# Altium schematic sheet ProbadorDeCables_Accesorios_B_CPC14.SchDoc
size A4
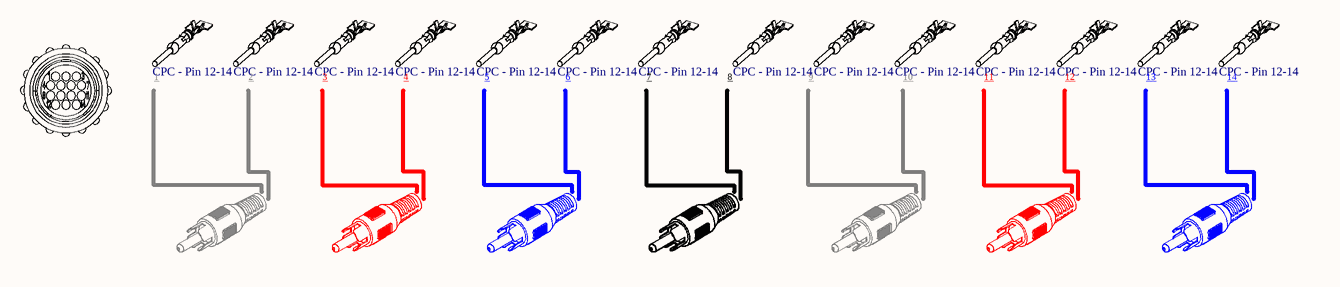
[diagram p0: ProbadorDeCables_Accesorios_B_CPC14.SchDoc]

## Parts
B_CPC14  CPC14 Macho  [BOM_CPC-14_Macho]  (value not drawn)  (mechanical)
BOM_B_CPC14__1  RCP-023__Blanco  [BOM_RCP-023__Blanco]  (value not drawn)  (mechanical)
BOM_B_CPC14__2  RCP-022__Rojo  [BOM_RCP-022__Rojo]  (value not drawn)  (mechanical)
BOM_B_CPC14__3  RCP-025__Azul  [BOM_RCP-025__Azul]  (value not drawn)  (mechanical)
BOM_B_CPC14__4  RCP-021__Negro  [BOM_RCP-021__Negro]  (value not drawn)  (mechanical)
BOM_B_CPC14__5  RCP-023__Blanco  [BOM_RCP-023__Blanco]  (value not drawn)  (mechanical)
BOM_B_CPC14__6  RCP-022__Rojo  [BOM_RCP-022__Rojo]  (value not drawn)  (mechanical)
BOM_B_CPC14__7  RCP-025__Azul  [BOM_RCP-025__Azul]  (value not drawn)  (mechanical)
BOM_B_CPC14__9  ParaHousing: CPC - Pin 12-14  [BOM_sock_CPC14_Macho]  (hidden comment: sock_CPC-Macho_66359-9)  (mechanical)
BOM_B_CPC14__10  ParaHousing: CPC - Pin 12-14  [BOM_sock_CPC14_Macho]  (hidden comment: sock_CPC-Macho_66359-9)  (mechanical)
BOM_B_CPC14__11  ParaHousing: CPC - Pin 12-14  [BOM_sock_CPC14_Macho]  (hidden comment: sock_CPC-Macho_66359-9)  (mechanical)
BOM_B_CPC14__12  ParaHousing: CPC - Pin 12-14  [BOM_sock_CPC14_Macho]  (hidden comment: sock_CPC-Macho_66359-9)  (mechanical)
BOM_B_CPC14__13  ParaHousing: CPC - Pin 12-14  [BOM_sock_CPC14_Macho]  (hidden comment: sock_CPC-Macho_66359-9)  (mechanical)
BOM_B_CPC14__14  ParaHousing: CPC - Pin 12-14  [BOM_sock_CPC14_Macho]  (hidden comment: sock_CPC-Macho_66359-9)  (mechanical)
BOM_B_CPC14__15  ParaHousing: CPC - Pin 12-14  [BOM_sock_CPC14_Macho]  (hidden comment: sock_CPC-Macho_66359-9)  (mechanical)
BOM_B_CPC14__16  ParaHousing: CPC - Pin 12-14  [BOM_sock_CPC14_Macho]  (hidden comment: sock_CPC-Macho_66359-9)  (mechanical)
BOM_B_CPC14__17  ParaHousing: CPC - Pin 12-14  [BOM_sock_CPC14_Macho]  (hidden comment: sock_CPC-Macho_66359-9)  (mechanical)
BOM_B_CPC14__18  ParaHousing: CPC - Pin 12-14  [BOM_sock_CPC14_Macho]  (hidden comment: sock_CPC-Macho_66359-9)  (mechanical)
BOM_B_CPC14__19  ParaHousing: CPC - Pin 12-14  [BOM_sock_CPC14_Macho]  (hidden comment: sock_CPC-Macho_66359-9)  (mechanical)
BOM_B_CPC14__20  ParaHousing: CPC - Pin 12-14  [BOM_sock_CPC14_Macho]  (hidden comment: sock_CPC-Macho_66359-9)  (mechanical)
BOM_B_CPC14__21  ParaHousing: CPC - Pin 12-14  [BOM_sock_CPC14_Macho]  (hidden comment: sock_CPC-Macho_66359-9)  (mechanical)
BOM_B_CPC14__22  ParaHousing: CPC - Pin 12-14  [BOM_sock_CPC14_Macho]  (hidden comment: sock_CPC-Macho_66359-9)  (mechanical)

## Notes on the sheet
- (near BOM_B_CPC14__10) 1
- (near BOM_B_CPC14__11) 2
- (near BOM_B_CPC14__12) 3
- (near BOM_B_CPC14__13) 4
- (near BOM_B_CPC14__14) 5
- (near BOM_B_CPC14__15) 6
- (near BOM_B_CPC14__16) 7
- (near BOM_B_CPC14__17) 8
- (near BOM_B_CPC14__18) 9
- (near BOM_B_CPC14__19) 10
- (near BOM_B_CPC14__20) 11
- (near BOM_B_CPC14__21) 12
- (near BOM_B_CPC14__22) 13
- 14

## Library data of the parts
B_CPC14 = CPC14_Macho: CONN PLUG HSG MALE 14POS INLINE; Cod.Fabricante: 206044-1; Fabricante: TE Connectivity AMP Connectors; Cod.DigiKey: A1358-ND; ComponentLink1Description: Manufacturer Link; ComponentLink1URL: https://www.te.com/commerce/DocumentDelivery/DDEController?Action=srchrtrv&DocNm=206044&DocType=Customer+Drawing&DocLang=English; DIGIKEYx50: 4.70220; DIGIKEYx100: 4.47820
BOM_B_CPC14__1 BOM_B_CPC14__5 = RCP-023__Blanco: CONN RCA PLUG MONO 2COND; Fabricante: CUI Devices; Cod.DigiKey: CP-1455-ND; Cod.Fabricante: RCP-023; ComponentLink1Description: Manufacturer Link; ComponentLink1URL: https://www.cuidevices.com/product/resource/digikeypdf/rcp-02x.pdf; DIGIKEYx50: 1.09940; DIGIKEYx100: 1.05160
BOM_B_CPC14__2 BOM_B_CPC14__6 = RCP-022__Rojo: CONN RCA PLUG MONO 2COND; Fabricante: CUI Devices; Cod.DigiKey: CP-1454-ND; Cod.Fabricante: RCP-022; ComponentLink1Description: Manufacturer Link; ComponentLink1URL: https://www.cuidevices.com/product/resource/digikeypdf/rcp-02x.pdf; DIGIKEYx50: 1.09940; DIGIKEYx100: 1.05160
BOM_B_CPC14__3 BOM_B_CPC14__7 = RCP-025__Azul: CONN RCA PLUG MONO 2COND; Fabricante: CUI Devices; Cod.DigiKey: CP-1457-ND; Cod.Fabricante: RCP-025; ComponentLink1Description: Manufacturer Link; ComponentLink1URL: https://www.cuidevices.com/product/resource/digikeypdf/rcp-02x.pdf; DIGIKEYx50: 1.09940; DIGIKEYx100: 1.05160
BOM_B_CPC14__4 = RCP-021__Negro: CONN RCA PLUG MONO 2COND; Fabricante: CUI Devices; Cod.DigiKey: CP-1453-ND; Cod.Fabricante: RCP-021; ComponentLink1Description: Manufacturer Link; ComponentLink1URL: https://www.cuidevices.com/product/resource/digikeypdf/rcp-02x.pdf; DIGIKEYx50: 1.09940; DIGIKEYx100: 1.05160
BOM_B_CPC14__9-BOM_B_CPC14__22 = sock_CPC-Macho_66359-9: CONN PIN 14-18AWG GOLD CRIMP; Fabricante: TE Connectivity AMP Connectors; Cod.DigiKey: A25127CT-ND; Cod.Fabricante: 66359-9; ComponentLink1Description: Manufacturer Link; ComponentLink1URL: https://www.te.com/commerce/DocumentDelivery/DDEController?Action=srchrtrv&DocNm=66359&DocType=Customer+Drawing&DocLang=English; DIGIKEYx100: 0.61360; DIGIKEYx50: 0.64160